# EasyEDA Pro project Foc驱动板.eprj, board PCB1_1 (continued)
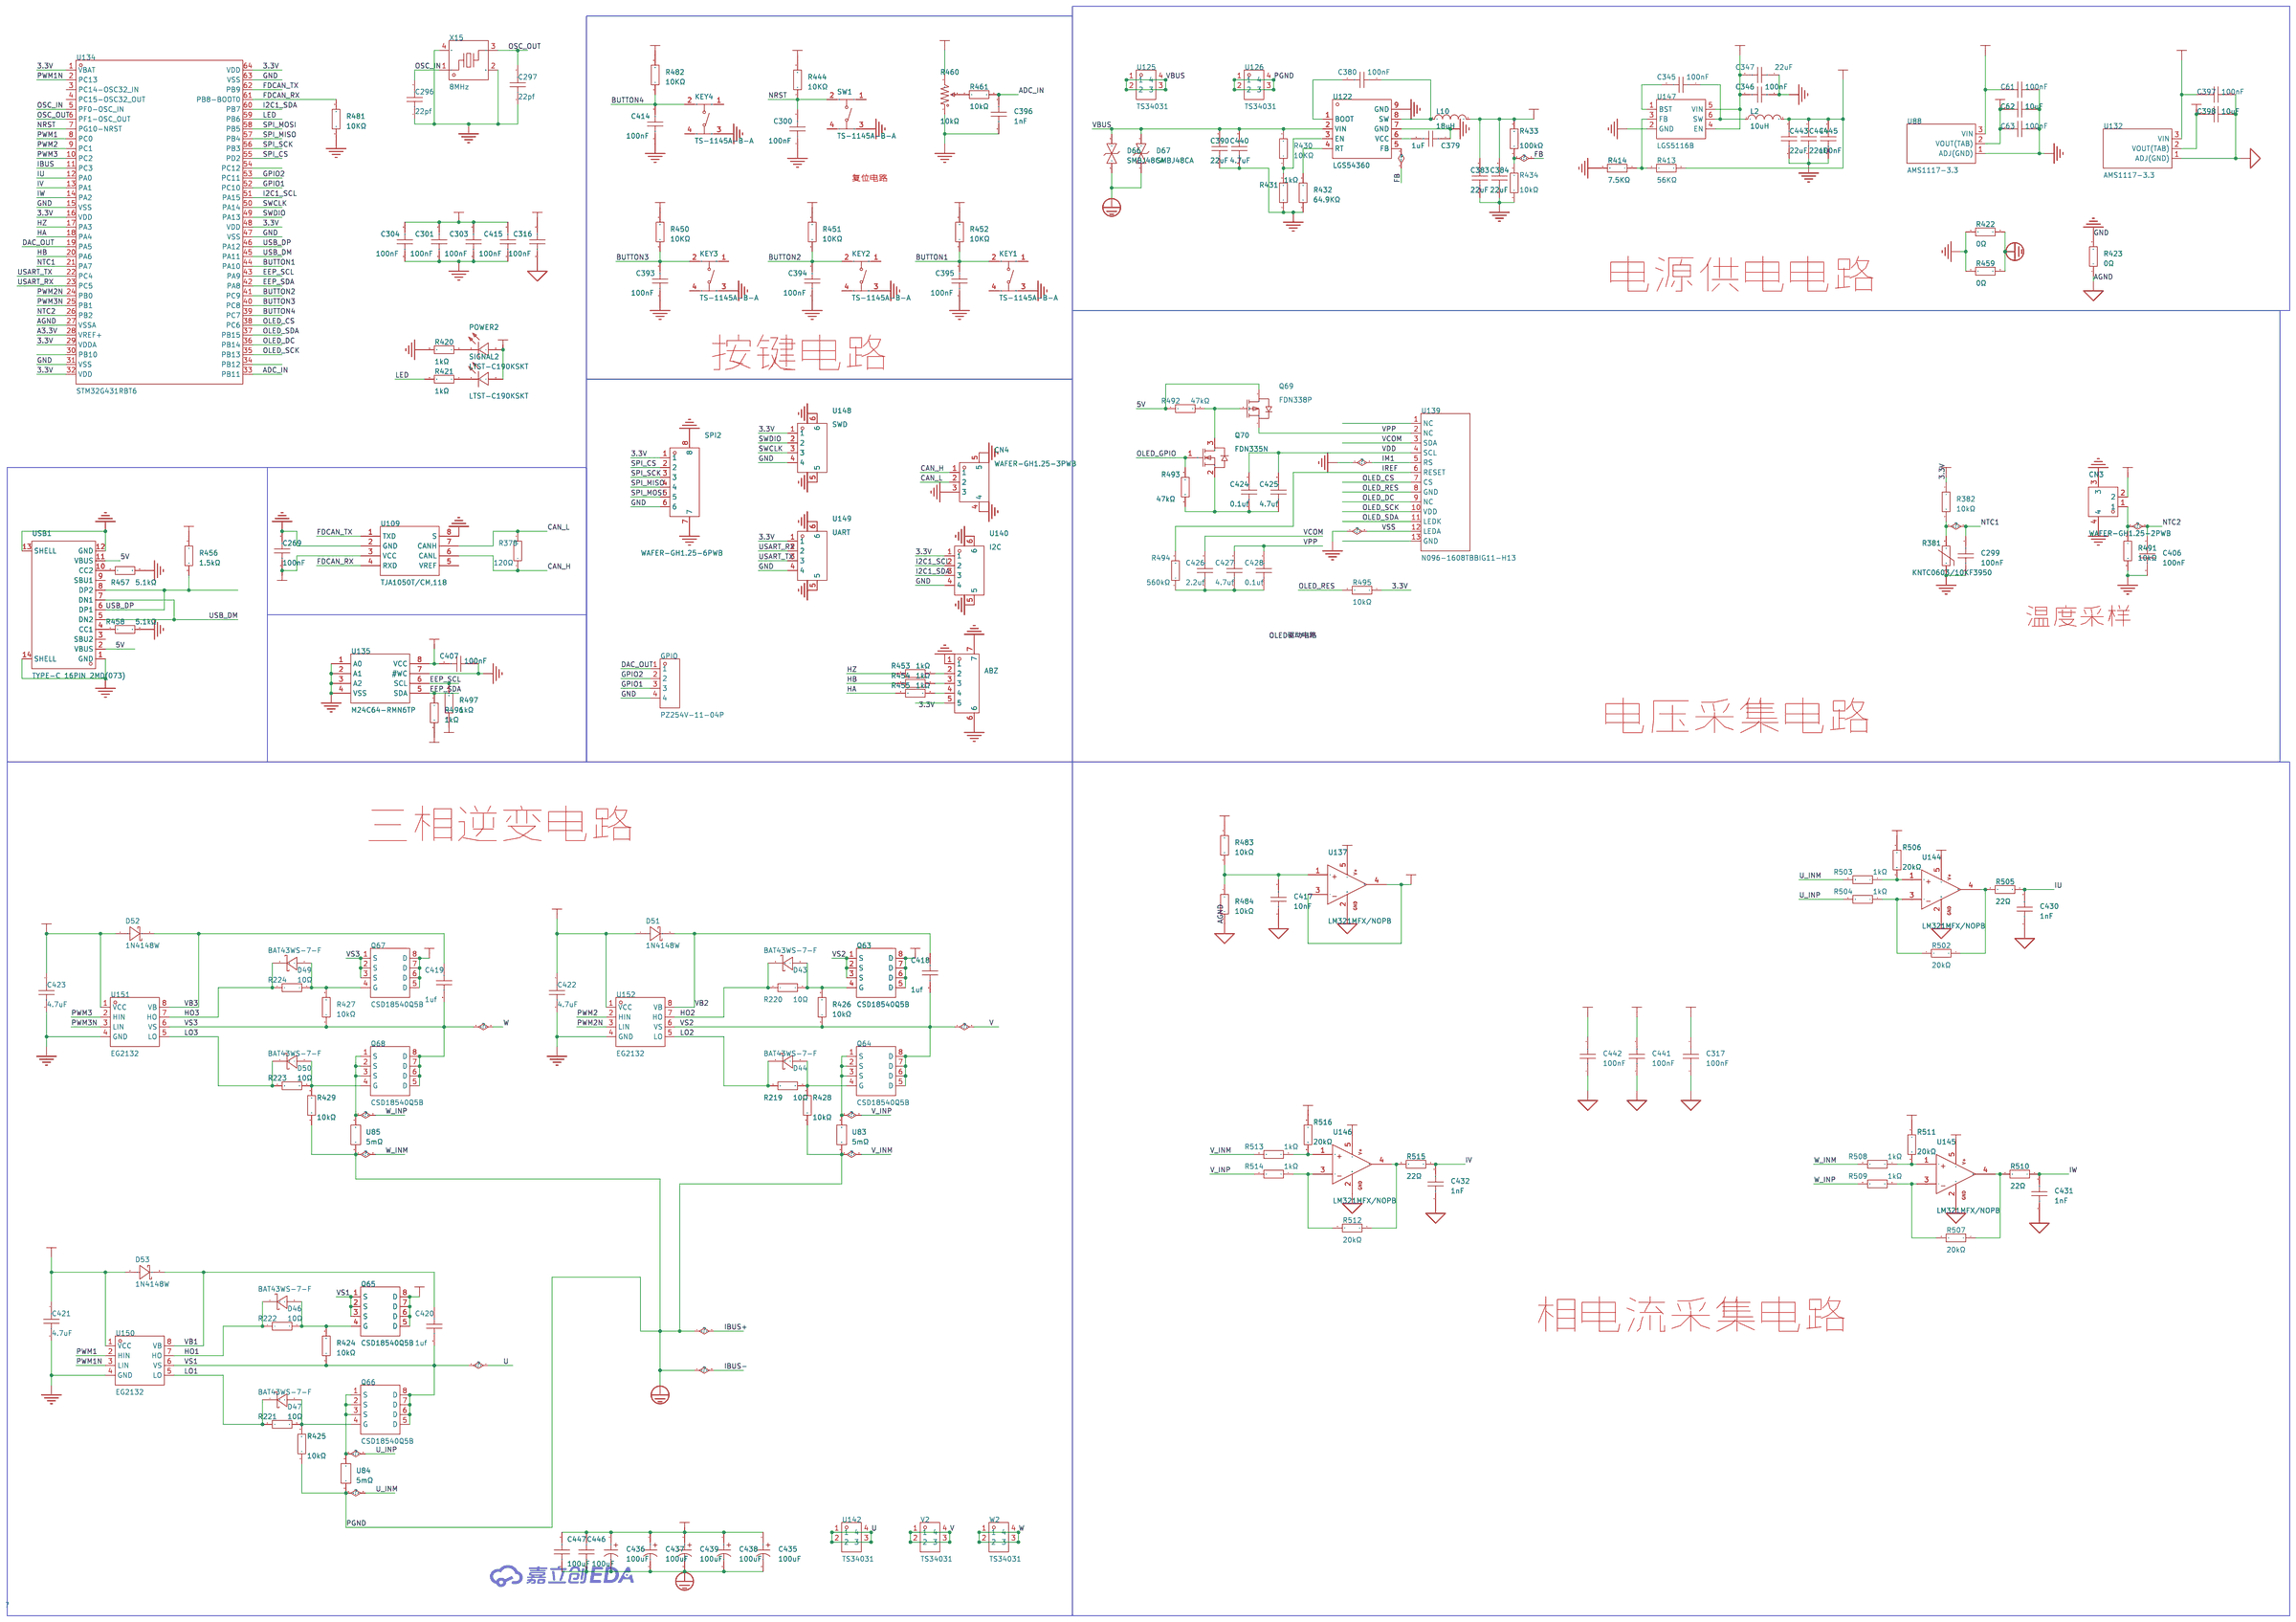
[diagram p0: schematic sheet]
## Nets (continued)
$1N9259: D43.2 Q63.4 R220.2 R426.2
$1N9267: D44.2 Q64.4 R219.2 R428.2
$1N9279: D50.2 Q68.4 R223.2 R429.2
$1N9280: D49.2 Q67.4 R224.2 R427.2
$1N9402: U134.54
$1N9439: U134.34
$1N9459: U134.30
$1N9505: C380.2 U122.1
$1N9518: 1.3 OLED.13
$1N9519: 1.3 OLED.1
$1N9527: NMOS.3 PMOS.1 R492.2
$1N9530: C424.1 C425.1 NMOS.2 R493.1
$1N9531: C426.1 C427.1 C428.1 R494.1
$1N9558: C417.2 R483.2 R484.1 U137.1
$1N10528: IU.3 R503.1 R506.2
$1N11288: IV.1 R512.1 R515.2
$1N24102: R413.2 R414.1 U147.3
$1N24243: C345.1 L2.1 U147.6
$1N30541: IV.3 R513.1 R516.2
$1N30545: IV.4 R512.2 R514.1
$1N30710: IW.3 R508.1 R511.2
$1N30717: IW.4 R507.2 R509.1
$1N30753: IW.1 R507.1 R510.2
$1N30817: IU.4 R502.2 R504.1
$1N30853: IU.1 R502.1 R505.2

Pads without a net: CANIC 5; KEY1 1 4; KEY2 1 4; KEY3 1 4; KEY4 1 4; RESET> 1 4; U134 3 4; USB 3 9

## Via types
v1: diameter 0.61, hole 0.305, Top Layer to Bottom Layer, 1010 vias
v2: diameter 0.508, hole 0.305, Top Layer to Bottom Layer, 92 vias

## Routing (per net, layer and track width the routed paths; a pad name or vN(x,y) marks a point on that pad's centre or on a via; arc(x,y) is an arc through that point)
3.3V: length 398.8
  Top Layer w0.254: v1(28.83,61.91) C301.2 27.94,64.13 28.25,64.45 U134.64 32.2,64.45 32.57,64.08 U134.1 ; 41.72,90.98 41.78,91.04 41.78,91.82 41.53,92.08 38.99,92.08 38.35,91.44 R496.2 R497.2 35.25,87.56 C407.2 34.48,87.24 EEPROM.8 ; 41.72,90.98 42.54,90.98 ; 41.72,90.98 41.68,90.93 41.15,90.93 40.64,90.42 40.64,84.07 40.98,83.74 POWER.2 ; 63.88,83.25 v1(63.88,84.21) ; 5.38,67.79 4.19,67.79 ; R495.1 v1(28.96,96.13) ; I2C.1 6.37,35.28 v1(6.4,35.31) ; U134.16 v1(40.64,62.45) ; U134.48 32.57,75 32,75.56 28,75.56 C304.2 27.94,74.8 ; C303.2 41.02,60.45 v1(40.64,60.07) ; 5.19,82.12 5.11,82.04 v1(3.94,82.04) ; SPI.1 v1(6.4,26.49) ; R456.1 v1(3.94,53.47) ; R452.2 v1(63.95,92.05) ; 5.38,76.8 5.29,76.71 v1(4.19,76.71) ; R482.2 63.93,68.4 v1(63.88,68.45) ; U134.29 40.68,70.45 40.39,70.74 40.39,71.63 40.71,71.95 U134.32 43.37,71.95 43.69,72.26 C415.2 44.51,74.48 v1(44.58,74.42) ; v1(46.99,69.41) 46.99,68.07 46.48,67.56 46.48,65.41 45.97,64.9 44.83,64.9 44.58,64.64 v1(44.58,62.23) ; R382.1 v1(49.66,34.16) ; v1(62.99,75.44) 63.79,75.44 R450.2
  Top Layer w0.381: v1(41.72,84.57) 41.72,83.77 POWER.2 ; R444.2 v1(58.17,83.95) v1(47.77,83.95)
  Top Layer w0.508: ABZ.5 v1(3.68,9.95)
  Inner2 w0.254: v1(63.88,68.45) 63.88,70.23 62.99,71.12 v1(62.99,75.44) 62.99,83.95 63.25,84.21 ; v1(49.66,34.16) v1(49.66,40.77) ; v1(40.64,60.07) 41.91,60.07 42.16,60.33 42.16,61.98 42.42,62.23 v1(44.58,62.23) ; 56.13,94.87 59.69,94.87 61.02,93.54 63.31,93.54 63.95,92.9 v1(63.95,92.05) 63.84,91.95 63.12,91.95 62.86,91.69 62.86,84.58 63.12,84.33 63.13,84.33 63.25,84.21 ; v1(27.94,74.8) 27.94,93.22 28.32,93.6 v1(28.96,93.6) ; 63.25,84.21 v1(63.88,84.21) ; 47.75,82.82 47.75,83.04 v1(47.77,83.06) ; v1(46.99,71.5) 43.56,71.5 42.8,70.74 38.61,70.74 38.1,70.23 38.1,62.61 37.4,61.91 v1(28.83,61.91)
  Inner2 w0.381: v1(28.96,96.13) 47.24,96.13 47.88,96.77 55.37,96.77 55.75,96.39 55.75,95.25 56.13,94.87 55.75,94.49 55.75,93.73 56.26,93.22 57.66,93.22 58.17,92.71 v1(58.17,83.95)
  Inner2 w0.762: v1(47.75,94.49) 47.24,95 13.84,95 9.91,91.06 5.08,91.06 3.94,89.92 v1(3.94,82.04) 3.94,76.96 v1(4.19,76.71) v1(4.19,67.82) 4.19,53.85 4.57,53.47 ; 4.57,53.47 v1(3.94,53.47) ; 4.57,53.47 4.95,53.09 4.95,35.69 5.33,35.31 v1(6.4,35.31) v1(6.4,26.49) 6.35,26.54 4.06,26.54 3.68,26.16 v1(3.68,9.95)
  Bottom Layer w0.254: v1(41.72,84.57) 46.35,84.57 v1(46.97,83.95) ; v1(46.99,71.5) 45.09,71.5 44.58,72.01 v1(44.58,74.42) ; v1(28.96,96.13) v1(28.96,93.6) ; v1(44.58,62.23) 49.28,62.23 49.53,61.98 49.53,56.13 51.44,54.23 51.44,50.16 50.93,49.66 50.93,47.24 52.07,46.1 52.07,42.39 51.59,41.91 49.91,41.91 49.66,41.66 v1(49.66,40.77) ; v1(40.64,60.07) v1(40.64,62.45)
  vias: v1(42.54,90.97) v1(46.97,83.06) v1(46.99,81.15) v1(46.99,80.14) v1(46.99,70.47) v1(47.78,81.15) v1(47.78,80.14) v1(47.88,71.5) v1(47.88,70.46) v1(47.88,69.37)
5V: length 107.1
  Top Layer w0.254: v1(20.32,58.61) C269.1 19.24,58.67 CANIC.3
  Top Layer w0.508: USB.11 v1(8.38,41.54) ; v1(8.38,46.35) 8.37,46.34 USB.2
  Inner2 w0.762: v1(29.59,82.68) 29.59,83.19 29.84,83.44 35.43,83.44 36.7,82.17 52.58,82.17 53.45,81.3 v1(53.45,77.47) ; v1(30.48,82.68) 30.61,82.55 33.27,82.55 34.04,81.79 34.04,79.76 35.18,78.61 35.18,69.98 34.67,69.47 21.21,69.47 20.7,68.96 20.7,58.99 v1(20.32,58.61) 15.17,58.61 13.97,59.82 9.4,59.82 8.89,59.31 8.89,46.99 8.38,46.48 v1(8.38,46.35) 9,45.74 9,42.16 v1(8.38,41.54)
  vias: v1(50.17,66.3) v1(51.02,67.18) v1(51.02,66.3) v1(51.82,66.29) v1(53.45,76.47) v1(54.48,77.47) v1(54.5,76.47)
12V: length 7.6
  Top Layer w0.254: 61.09,58.67 66.8,58.67 67.56,57.91 R433.2
  vias: v1(23.56,44.78) v1(23.56,43.88) v1(24.45,44.78) v1(24.45,43.87) v1(36,45.03) v1(36,44.14) v1(36.89,45.03) v1(36.89,44.12) v1(48.7,45.16) v1(48.7,44.27) v1(49.59,45.16) v1(49.59,44.25) v1(50.48,45.16) v1(50.48,44.27) v1(51.37,45.16) v1(51.37,44.25) v1(52.96,59.05) v1(52.96,58.16) v1(53.85,59.05) v1(53.85,58.15) v1(54.74,59.05) v1(54.74,58.11) v1(55.63,59.05) v1(55.63,58.11) v1(56.51,59.05) v1(56.51,58.12)
A3.3V: length 68
  Top Layer w0.254: U137.5 48.23,57.91 47.75,57.91 47.5,58.17 47.5,59.88 47.06,60.33 C398.1 ; U137.5 48.29,57.31 v1(48.26,57.28) ; U137.5 48.29,58.52 v1(48.26,58.55) ; v1(41.28,58.55) 41.95,58.55 R483.1 ; v1(34.8,51.18) 34.83,51.21 IV.5 34.83,53.31 C441.2 ; v1(44.07,70.1) 43.91,69.95 U134.28 ; 21.14,53.47 21.14,52.16 IU.5 21.08,52.1 v1(21.08,51.31) ; v1(48.01,54.36) 47.62,54.36 47.43,54.16 C442.2 47.43,52.04 IW.5 47.4,51.21 v1(47.37,51.18)
  Inner2 w0.254: v1(47.37,51.18) v1(34.8,51.18) 21.21,51.18 v1(21.08,51.31) ; v1(41.28,58.55) v1(48.26,58.55)
  Bottom Layer w0.254: v1(48.26,57.28) 48.01,57.02 v1(48.01,54.36) ; v1(44.07,70.1) 41.78,70.1 41.28,69.6 v1(41.28,58.55)
AGND: length 95.9
  Top Layer w0.254: v1(48.77,52.35) 48.83,52.41 C442.1 48.83,54.29 49.4,54.86 49.4,58.8 49.78,59.18 50.29,59.18 50.67,59.56 50.67,60.26 C398.2 ; 46.23,52.32 46.1,52.2 46.1,51.31 45.85,51.05 IW.2 43.75,51.05 43.18,50.48 ; v1(33.53,52.37) 33.53,51.44 33.15,51.05 IV.2 30.8,51.05 V_OUT.1 ; C398.2 v1(51.31,60.33) ; C398.2 50.61,61.6 U132.1 52.6,62.25 52.96,62.61 R423.1 52.96,67.44 52.32,68.07 49.15,68.07 48.83,67.75 48.83,67.18 v1(48.01,67.18) ; v1(44.97,60.2) 45.47,60.2 46.74,58.93 46.74,57.28 46.48,57.02 U137.2 v1(44.83,57.02) ; v1(44.96,69.85) 44.56,69.45 U134.27 ; v1(19.81,52.38) 19.81,51.44 19.56,51.18 17.21,51.18 U_OUT.1 ; 22.54,53.47 22.61,53.41 22.61,52.58 22.67,52.51 v1(22.67,52.32) ; v1(41.28,57.02) 41.99,57.02 R484.2 42.1,56.91 C417.1 ; v1(36.19,52.35) 36.26,52.41 C441.1
  Inner2 w0.254: v1(19.81,52.38) 22.61,52.38 v1(22.67,52.32) 36.17,52.32 v1(36.19,52.35) v1(46.16,52.35) v1(48.77,52.35) ; v1(44.83,57.02) v1(41.28,57.02) ; v1(44.97,60.2) 51.18,60.2 v1(51.31,60.33)
  Bottom Layer w0.254: v1(48.01,67.18) 45.59,67.18 44.96,67.82 v1(44.96,69.85)
GND: length 107
  Top Layer w0.254: U134.15 39.57,63.58 39.75,63.75 43.18,63.75 43.43,63.5 v1(43.43,63.12) ; C423.2 46.54,42.99 v1(46.48,42.93) ; v1(33.07,76.45) v1(33.07,75.66) U134.47 ; v1(37.08,81.03) 37.08,79.33 EEPROM.3 ; v1(26.3,60.51) v1(25.4,60.51) ; v1(26.3,60.51) C301.1 ; v1(26.3,60.51) 26.3,64.15 27.1,64.95 U134.63 ; R481.1 21.54,57.21 C269.2 19.11,57.4 CANIC.2 ; v1(14.15,79.12) v1(14.15,78.08) 1.3 OLED.12 ; X15.2 37.06,56.81 C297.1 38.04,56.96 v1(38.61,56.39) ; EEPROM.7 35.75,84.26 34.48,82.99 EEPROM.1 ; EEPROM.2 35.69,79.32 v1(35.69,80.77) ; 1.3 OLED.5 19.05,73.28 v1(19.05,79.12) 19.05,80.12 v1(19.06,80.13) ; C303.1 44.2,60.45 v1(44.2,60.45) ; v1(7.58,56.39) 9.91,56.39 10.16,56.13 CANIC.8 ; v1(44.83,77.47) 44.83,76.2 44.51,75.88 C415.1 ; v1(44.58,70.87) 43.99,71.45 U134.31 ; v1(48.89,29.84) 49.03,29.84 R381.1 C299.1 ; v1(38.3,81.03) 38.3,79.28 EEPROM.4 41.07,79.26 R420.2 ; v1(67.06,49.15) 67.06,49.16 R432.1 ; X15.4 30.63,58.51 C296.1 29.91,57.78 v1(29.34,57.78)
  Inner2 w0.254: v1(48.89,29.84) 48.89,41.78 48.51,42.16 46.74,42.16 46.48,42.42 v1(46.48,42.93)
  Bottom Layer w0.254: 44.2,60.45 43.69,60.45 43.43,60.71 v1(43.43,63.12) ; v1(38.61,59.05) v1(38.61,57.66) v1(38.61,56.39) 38.61,55.88 38.23,55.5 v1(37.34,55.5) v1(35.94,55.5) v1(34.54,55.5) v1(33.15,55.5) v1(31.75,55.5) v1(30.35,55.5) 30.1,55.5 v1(29.34,56.26) v1(29.34,57.78) v1(29.34,59.05)
  vias: v1(0.81,24.26) v1(0.8,23.37) v1(0.8,22.48) v1(0.8,13.34) v1(0.79,12.45) v1(0.79,11.56) v1(1.09,83.62) v1(1.08,82.74) v1(1.08,81.85) v1(1.17,33.4) v1(1.17,32.51) v1(1.21,66.8) v1(1.2,65.91) v1(1.2,65.02) v1(1.18,34.29) v1(1.27,3.68) v1(1.32,75.82) v1(1.31,74.93) v1(1.31,74.04) v1(1.34,59.04) v1(1.33,58.15) v1(1.33,57.26) v1(1.4,96.27) v1(1.4,53.59) v1(1.7,24.26) v1(1.69,23.37) v1(1.69,22.48) v1(1.68,13.34) v1(1.68,12.45) v1(1.68,11.56) v1(1.78,5.08) v1(1.91,97.66) v1(1.97,82.74) v1(1.97,81.85) v1(1.91,2.16) v1(2.03,94.74) v1(1.98,83.62) v1(2.07,34.29) v1(2.06,33.4) v1(2.06,32.51) v1(2.1,66.8) v1(2.09,65.91) v1(2.09,65.02) v1(2.21,75.82) v1(2.2,74.93) v1(2.2,74.04) v1(2.23,59.04) v1(2.22,58.15) v1(2.22,57.26) v1(2.27,44.32) v1(2.27,43.43) v1(2.3,53.59) v1(2.6,24.26) v1(2.6,23.37) v1(2.6,22.48) v1(2.59,13.34) v1(2.58,12.45) v1(2.58,11.56) v1(2.88,83.62) v1(2.88,82.74) v1(2.88,81.85) v1(2.97,33.4) v1(2.97,32.51) v1(3,66.8) v1(3,65.91) v1(3,65.02) v1(2.98,34.29) v1(3.11,75.82) v1(3.11,74.93) v1(3.11,74.04) v1(3.13,59.04) v1(3.13,58.15) v1(3.13,57.26) v1(3.16,44.32) v1(3.16,43.43) v1(3.43,5.84) v1(3.43,1.53) v1(3.56,98.42) v1(3.56,94.11) v1(4.97,2.16) v1(5.01,5.08) v1(5.13,97.66) v1(5.1,94.74) v1(5.62,3.68) v1(5.75,96.27) v1(6.97,62.61) v1(6.97,61.72) v1(6.98,63.5) v1(7.11,52.51) v1(7.37,19.81) v1(7.36,18.92) v1(7.36,18.03) v1(7.87,63.5) v1(7.86,62.61) v1(7.86,61.72) v1(8,8.37) v1(7.99,7.48) v1(7.99,6.59) v1(8,5.72) v1(7.99,4.83) v1(7.99,3.94) v1(8,3.05) v1(7.99,2.16) v1(7.99,1.27) v1(8.25,19.81) v1(8.25,18.92) v1(8.25,18.03) v1(8.89,8.37) v1(8.88,7.48) v1(8.88,6.59) v1(8.89,5.72) v1(8.88,4.83) v1(8.88,3.94) v1(8.89,3.05) v1(8.88,2.16) v1(8.88,1.27) v1(9.16,19.81) v1(9.15,18.92) v1(9.15,18.03) v1(9.79,8.37) v1(9.78,7.48) v1(9.78,6.59) v1(9.79,5.72) v1(9.78,4.83) v1(9.78,3.94) v1(9.79,3.05) v1(9.78,2.16) v1(9.78,1.27) v1(13.71,87.38) v1(13.7,86.49) v1(13.7,85.6) v1(14.06,42.59) v1(14.05,41.7) v1(14.05,40.81) v1(14.6,87.38) v1(14.59,86.49) v1(14.59,85.6) v1(14.95,42.59) v1(14.94,41.7) v1(14.94,40.81) v1(15.51,87.38) v1(15.5,86.49) v1(15.5,85.6) v1(19.43,55.37) v1(20.71,55.37) v1(21.2,87.5) v1(21.2,86.61) v1(21.2,85.72) v1(21.95,55.37) v1(22.09,87.5) v1(22.09,86.61) v1(22.09,85.72) v1(22.61,57.78) v1(22.61,56.77) v1(23,87.5) v1(22.99,86.61) v1(22.99,85.72) v1(23.2,55.36) v1(23.46,57.78) v1(23.51,56.77) v1(25.21,76.39) v1(25.21,75.5) v1(25.21,74.49) v1(25.21,73.6) v1(26.1,76.39) v1(26.1,75.5) v1(26.1,74.49) v1(26.1,73.6) v1(26.8,25.65) v1(28.35,42.4) v1(28.35,41.51) v1(29.24,42.4) v1(29.24,41.51) v1(29.4,63.56) v1(29.4,62.67) v1(29.78,74.49) v1(29.78,73.6) v1(30.29,63.56) v1(30.29,62.67) v1(30.67,74.49) v1(30.67,73.6) v1(33.46,89.34) v1(33.46,88.46) v1(33.53,68.58) v1(34.36,90.28) v1(34.64,68.58) v1(35.25,90.28) v1(36.32,70.38) v1(36.32,68.58) v1(37.34,70.36) v1(39.27,68.58) v1(39.37,70.1) v1(41.64,42.42) v1(41.64,41.53) v1(42.1,73.22) v1(42.53,42.42) v1(42.53,41.53) v1(42.99,73.22) v1(51.43,71.63) v1(51.42,70.74) v1(51.44,69.85) v1(51.44,68.98) v1(52.32,71.63) v1(52.31,70.74) v1(52.96,61.09) v1(52.96,60.2) v1(53.85,60.2) v1(54.35,86.74) v1(54.34,85.85) v1(54.34,84.96) v1(54.35,82.93) v1(54.34,82.04) v1(54.34,81.15) v1(54.36,80.26) v1(55.24,86.74) v1(55.23,85.85) v1(55.23,84.96) v1(56.15,86.74) v1(56.14,85.85) v1(56.14,84.96) v1(57.73,63.04) v1(57.73,61.94) v1(57.73,60.81) v1(58.04,56.13) v1(58.04,55.43) v1(58.93,50.04) v1(59.44,50.8) v1(59.69,76.07) v1(59.68,75.18) v1(59.68,74.3) v1(59.81,86.74) v1(59.81,85.85) v1(59.81,84.96) v1(60.03,50.04) v1(60.57,76.07) v1(60.57,75.18) v1(60.57,74.3) v1(60.7,86.74) v1(60.69,85.85) v1(60.69,84.96) v1(60.68,50.8) v1(61.28,50.04) v1(61.47,76.07) v1(61.46,75.18) v1(61.46,74.3) v1(61.61,86.74) v1(61.6,85.85) v1(61.6,84.96) v1(62.36,55.24) v1(62.43,54.41) v1(62.44,53.47) v1(63.37,53.47) v1(63.4,55.24) v1(63.4,54.41) v1(63.93,62.13) v1(64.01,96.14) v1(64.45,55.24) v1(64.45,54.38) v1(64.45,53.47) v1(64.52,97.54) v1(64.64,94.61) v1(65.51,84.78) v1(65.51,77) v1(65.53,69.21) v1(66.17,98.3) v1(66.17,93.98) v1(66.29,46.74) v1(66.32,45.85) v1(66.63,85.87) v1(66.62,84.78) v1(66.63,83.63) v1(66.63,78.09) v1(66.62,77) v1(66.63,75.85) v1(66.66,70.31) v1(66.65,69.21) v1(66.66,68.06) v1(66.8,52.32) v1(67.75,97.54) v1(67.71,94.61) v1(67.81,84.78) v1(67.81,77) v1(67.83,69.21) v1(68.36,96.14) v2(11.94,14.8) v2(11.94,13.91) v2(11.94,12.89) v2(12.7,18.73) v2(12.7,17.84) v2(12.7,16.83) v2(12.7,14.8) v2(12.7,13.91) v2(12.7,12.89) v2(12.83,46.74) v2(12.83,45.72) v2(12.83,44.7) v2(12.83,43.69) v2(12.83,42.67) v2(12.83,41.66) v2(12.83,40.64) v2(12.83,39.75) v2(12.83,38.73) v2(12.83,35.5) v2(12.83,34.61) v2(12.83,33.59) v2(12.83,26.1) v2(12.83,25.08) v2(26.29,18.61) v2(26.29,17.72) v2(26.29,16.7) v2(26.54,45.97) v2(26.54,43.05) v2(26.54,42.16) v2(26.54,41.15) v2(26.54,40.22) v2(26.54,39.24) v2(26.54,38.35) v2(34.42,66.42) v2(36.32,66.45) v2(37.97,42.93) v2(37.97,42.04) v2(37.97,41.02) v2(37.97,40) v2(37.97,38.99) v2(37.97,37.97) v2(39.24,66.42) v2(39.37,37.72) v2(39.5,42.55) v2(39.5,41.53) v2(39.5,40.51) v2(39.5,39.5) v2(39.5,38.48) v2(39.5,26.61) v2(39.5,25.59) v2(39.5,18.73) v2(39.5,17.84) v2(39.5,16.83)
PGND: length 187.4
  Top Layer w0.203: v2(19.75,47.27) 19.71,47.32 R503.2 ; 45.47,12.17 45.47,14.99 45.21,15.24 41.66,15.24 v1(41.4,14.99) ; v1(28.45,14.86) 28.78,15.19 32.18,15.19 32.38,14.99 U83.1 ; v2(46.19,47.15) 46.15,47.19 R508.2 ; R513.2 33.72,47.32 ; v1(14.86,15.24) 15.11,15.49 18.67,15.49 18.92,15.24 18.92,12.43
  Top Layer w0.381: 15.11,10.16 13.72,10.16 13.34,10.53 R425.1 ; R429.1 40.17,20.29 40.17,10.13 ; R428.1 27.18,19.82 27.18,10.42
  Inner2 w0.203: 38.56,15.88 38.56,47.45 arc(38.7,47.79) 39.04,47.93 45.92,47.93 arc(46.11,47.85) 46.19,47.66 v2(46.19,47.15) ; 38.56,15.88 38.56,15.75 ; 38.56,15.88 arc(38.72,15.48) 39.12,15.32 41.07,15.32 v1(41.4,14.99) ; v1(14.86,15.24) 14.53,15.57 12.32,15.57 arc(12.01,15.7) 11.89,16 11.89,47.5 arc(12.11,48.04) 12.65,48.26 19.3,48.26 arc(19.57,48.15) 19.69,47.88 19.69,47.34 v2(19.75,47.27) ; v2(33.62,47.27) 33.62,47.66 arc(33.54,47.85) 33.35,47.93 26.67,47.93 26.66,47.94 25.95,47.94 25.48,47.47 25.48,15.66 arc(25.61,15.33) 25.95,15.19 28.12,15.19 v1(28.45,14.86)
  vias: v1(22.81,11.3) v1(23.62,11.3) v1(24.38,11.3) v1(36.19,11.18) v1(37.04,11.18) v1(38.02,11.18) v1(52.57,31.38) v1(52.51,21.98) v1(52.51,21.09) v1(52.51,20.2) v1(52.52,19.17) v1(52.52,18.28) v1(52.52,17.4) v1(52.57,12.19) v1(52.58,30.49) v1(52.58,29.6) v1(52.58,28.57) v1(52.58,27.68) v1(52.58,26.79) v1(52.58,11.3) v1(52.58,10.41) v1(52.58,9.38) v1(52.58,8.49) v1(52.58,7.6) v1(53.02,45.29) v1(53.02,44.39) v1(53.09,47.06) v1(53.09,46.17) v1(53.47,31.37) v1(53.47,30.48) v1(53.47,29.59) v1(53.47,28.56) v1(53.41,21.97) v1(53.41,21.09) v1(53.41,20.2) v1(53.41,19.17) v1(53.41,18.28) v1(53.41,17.39) v1(53.47,12.18) v1(53.47,11.29) v1(53.47,10.4) v1(53.47,9.37) v1(53.48,27.67) v1(53.48,26.78) v1(53.48,8.48) v1(53.48,7.59) v1(53.85,47.06) v1(53.85,46.15) v1(53.78,45.29) v1(53.78,44.38) v1(54.36,31.37) v1(54.36,30.48) v1(54.36,29.59) v1(54.36,28.56) v1(54.36,27.67) v1(54.36,26.78) v1(54.29,21.97) v1(54.3,21.09) v1(54.3,20.2) v1(54.3,19.17) v1(54.3,18.28) v1(54.3,17.39) v1(54.36,12.18) v1(54.36,11.29) v1(54.36,10.4) v1(54.36,9.37) v1(54.36,8.48) v1(54.36,7.59) v1(54.67,45.29) v1(54.67,44.39) v1(54.74,47.06) v1(54.74,46.17) v1(55.24,31.37) v1(55.24,30.48) v1(55.24,29.59) v1(55.25,28.56) v1(55.25,27.67) v1(55.25,26.78) v1(55.18,21.97) v1(55.18,21.09) v1(55.18,20.2) v1(55.18,19.17) v1(55.19,18.28) v1(55.19,17.39) v1(55.24,12.18) v1(55.24,11.29) v1(55.24,10.4) v1(55.25,9.37) v1(55.25,8.48) v1(55.25,7.59) v1(55.56,45.29) v1(55.56,44.38) v1(55.63,47.06) v1(55.63,46.15) v1(56.77,47.06) v1(56.77,46.17) v1(56.77,45.28) v1(57.53,47.04) v1(57.53,46.17) v1(57.53,45.27) v1(58.42,46.17) v1(58.42,45.28) v1(59.31,46.1) v1(59.31,45.27) v1(60.2,46.1) v1(60.2,45.21) v1(61.65,15.18) v1(61.6,14.16) v1(61.65,13.14) v1(62.39,22.36) v1(62.42,21.4) v1(62.42,20.51) v1(62.56,14.16) v1(62.6,15.18) v1(62.6,13.14) v1(63.28,22.36) v1(63.31,21.4) v1(63.31,20.51) v1(63.47,14.16) v1(63.51,15.18) v1(63.51,13.14) v1(64.01,3.56) v1(64.16,22.36) v1(64.2,21.4) v1(64.2,20.51) v1(64.44,15.18) v1(64.4,14.16) v1(64.44,13.14) v1(64.52,4.95) v1(64.64,2.03) v1(65.18,22.36) v1(65.21,21.4) v1(65.21,20.51) v1(65.46,19.59) v1(65.46,18.71) v1(65.46,17.81) v1(65.46,16.98) v1(65.46,16.06) v1(65.46,15.11) v1(65.46,14.16) v1(65.46,13.17) v1(65.46,12.21) v1(65.46,11.26) v1(65.46,10.43) v1(65.46,9.51) v1(65.46,8.6) v1(66.06,25.17) v1(66.04,24.38) v1(66.04,23.54) v1(66.07,22.36) v1(66.11,21.4) v1(66.11,20.51) v1(66.17,5.72) v1(66.17,1.4) v1(66.45,14.16) v1(66.49,15.18) v1(66.49,13.14) v1(66.96,22.36) v1(66.99,21.4) v1(66.99,20.51) v1(67.44,15.18) v1(67.4,14.16) v1(67.44,13.14) v1(67.75,4.95) v1(67.71,2.03) v1(67.84,22.36) v1(67.88,21.4) v1(67.88,20.51) v1(68.36,15.18) v1(68.32,14.16) v1(68.36,13.14) v1(68.36,3.56)
VBUS: length 7.7
  Top Layer w0.254: R430.2 68.57,48.89 v1(68.58,48.89)
  Bottom Layer w0.254: v1(62.75,50.18) 62.77,50.16 68.07,50.16 68.58,49.66 v1(68.58,48.89)
  vias: v1(54.54,40.12) v1(54.54,39.24) v1(54.54,38.35) v1(54.54,37.32) v1(54.55,36.43) v1(54.55,35.54) v1(55.43,40.12) v1(55.43,39.24) v1(55.43,38.35) v1(55.43,37.32) v1(55.43,36.43) v1(55.43,35.54) v1(56.31,40.12) v1(56.31,39.24) v1(56.31,38.35) v1(56.31,37.32) v1(56.32,36.43) v1(56.32,35.54) v1(57.32,40.13) v1(57.33,39.24) v1(57.33,38.35) v1(57.33,37.32) v1(57.33,36.43) v1(57.33,35.54) v1(58.22,40.12) v1(58.22,39.23) v1(58.22,38.34) v1(58.22,37.31) v1(58.23,36.42) v1(58.23,35.53) v1(59.15,43.14) v1(59.15,42.25) v1(59.14,41.35) v1(59.11,40.12) v1(59.11,39.23) v1(59.11,38.34) v1(59.11,37.31) v1(59.11,36.42) v1(59.11,35.53) v1(59.99,40.12) v1(59.99,39.23) v1(59.99,38.34) v1(60,37.31) v1(60,36.42) v1(60,35.53) v1(60.17,41.35) v1(60.18,44.02) v1(60.18,43.14) v1(60.18,42.25) v1(60.96,40.14) v1(60.96,39.25) v1(60.96,38.36) v1(60.96,37.33) v1(60.96,36.44) v1(61.07,44.02) v1(61.07,43.14) v1(61.07,42.25) v1(61.06,41.36) v1(61.46,34.61) v1(61.5,35.62) v1(61.5,33.59) v1(61.96,44.02) v1(61.96,43.14) v1(61.96,42.25) v1(61.95,41.36) v1(62.04,28.26) v1(62.04,27.37) v1(62.1,26.57) v1(62.45,35.62) v1(62.41,34.61) v1(62.45,33.59) v1(62.83,44.02) v1(62.83,43.13) v1(62.83,42.24) v1(62.82,41.35) v1(62.93,28.26) v1(62.93,27.37) v1(62.99,26.57) v1(63.37,35.62) v1(63.33,34.61) v1(63.37,33.59) v1(63.72,44.02) v1(63.72,43.14) v1(63.72,42.25) v1(63.71,41.35) v1(63.82,28.26) v1(63.82,27.37) v1(63.88,26.57) v1(64.25,34.61) v1(64.26,25.15) v1(64.26,24.38) v1(64.26,23.58) v1(64.3,35.62) v1(64.3,33.59) v1(64.61,44.02) v1(64.61,43.14) v1(64.61,42.25) v1(64.6,41.35) v1(64.83,28.26) v1(64.83,27.37) v1(64.89,26.57) v1(65.31,40.04) v1(65.31,39.15) v1(65.31,38.25) v1(65.31,37.43) v1(65.31,36.51) v1(65.31,35.56) v1(65.31,34.61) v1(65.31,33.61) v1(65.31,32.65) v1(65.31,31.71) v1(65.31,30.87) v1(65.31,29.96) v1(65.31,29.05) v1(65.64,44.02) v1(65.64,43.14) v1(65.64,42.25) v1(65.63,41.35) v1(65.72,28.25) v1(65.72,27.36) v1(65.78,26.57) v1(66.34,35.62) v1(66.3,34.61) v1(66.34,33.59) v1(66.53,44.02) v1(66.53,43.14) v1(66.53,42.25) v1(66.52,41.36) v1(66.61,28.25) v1(66.61,27.36) v1(66.67,26.57) v1(67.25,34.61) v1(67.3,35.62) v1(67.3,33.59) v1(67.42,44.02) v1(67.42,43.14) v1(67.42,42.25) v1(67.41,41.36) v1(67.5,28.25) v1(67.5,27.36) v1(67.56,26.57) v1(68.17,34.61) v1(68.21,35.62) v1(68.21,33.59)
VDD: length 29.3
  Top Layer w0.254: C425.2 30,92.58 20.45,92.58 19.75,91.89 1.3 OLED.4
ADC_IN: length 30.2
  Top Layer w0.127: U134.33 40.07,77.16 40.51,77.6 43.05,77.6 43.18,77.72 43.18,91.57 44.05,92.43 v1(49.53,92.43) ; C396.2 v1(49.53,92.43) ; v1(49.53,92.43) R461.2
BUTTON1: length 49.9
  Top Layer w0.127: v1(33.15,78.36) 33.15,78.23 34.57,76.81 U134.44
  Top Layer w0.254: KEY1.2 65.66,90.97 65.66,90.04 65.29,89.67 R452.1 v1(63.95,88.74) C395.2
  Bottom Layer w0.127: v1(33.15,78.36) 50.55,78.36 51.82,79.63 62.86,79.63 63.12,79.88 63.12,88.52 63.25,88.65 64.01,88.65
BUTTON2: length 38.6
  Top Layer w0.127: U134.41 v2(36.07,76.58)
  Top Layer w0.254: 63.88,79.95 v1(63.88,80.91) R451.1 65.11,81.74 65.6,82.24 KEY2.2
  Bottom Layer w0.127: 63.88,80.77 63.88,79.76 63.37,79.25 51.94,79.25 51.31,78.61 51.31,76.83 51.05,76.58 37.8,76.58 37.76,76.54 37.33,76.54 37.29,76.58 v2(36.07,76.58)
BUTTON3: length 41.7
  Top Layer w0.127: U134.40 36.6,73.98 v2(36.6,76.05)
  Top Layer w0.254: C393.2 63.8,72.22 R450.1 65.05,73.94 65.6,74.49 KEY3.2
  Bottom Layer w0.127: v1(63.75,73.02) 63.75,78.1 62.99,78.87 52.07,78.87 51.56,78.36 51.56,76.45 51.16,76.05 v2(36.6,76.05)
BUTTON4: length 46.3
  Top Layer w0.127: U134.39 37.08,73.95 v2(37.08,75.56)
  Top Layer w0.254: R482.1 65.36,66.12 65.66,66.42 65.66,67.57 KEY4.2
  Bottom Layer w0.127: v2(37.08,75.56) 51.18,75.56 51.82,76.2 51.82,78.1 52.32,78.61 61.47,78.61 62.23,77.85 62.23,66.04 62.99,65.28 63.88,65.28
  vias: v1(63.93,65.28)
CAN_H: length 5.9
  Top Layer w0.254: 5.37,58.92 120.1 8.88,58.67 CANIC.6
CAN_L: length 5.9
  Top Layer w0.254: 5.38,57.67 8.38,57.67 120.2 8.64,57.4 CANIC.7
DAC_OUT: length 46.8
  Top Layer w0.127: v1(46.35,91.44) 46.35,82.8 45.97,82.42 45.97,65.91 45.51,65.45 U134.19
  Bottom Layer w0.127: v1(46.35,91.44) 46.35,95.38 45.72,96.01 35.05,96.01 34.67,96.39 预留GPIO:1->4
1:DAC 2:PC10
3:PC11 4:GND.1
EEP_SCL: length 15.3
  Top Layer w0.127: R497.1 37.02,87.2 EEPROM.6 37.08,84.61 37.08,83.31 36.7,82.93 35.43,82.93 35.07,82.57 U134.43
EEP_SDA: length 15.5
  Top Layer w0.127: U134.42 35.57,77.61 35.81,77.85 36.07,77.85 36.32,78.1 36.32,81.66 36.83,82.17 37.85,82.17 38.35,82.68 38.35,84.61 EEPROM.5 38.29,87.45 R496.1
FB: length 5.3
  Top Layer w0.254: U122.5 66.12,57.32 66.55,56.9 66.55,56.01 66.92,55.63 R433.1 R434.2
FDCAN_RX: length 21.9
  Top Layer w0.127: CANIC.4 21.21,59.94 arc(21.48,59.83) 21.59,59.56 R481.2 arc(21.59,58.67) 21.6,58.67 23.24,58.67 arc(23.6,58.82) 23.75,59.18 23.75,65.28 arc(23.95,65.75) 24.42,65.95 U134.61
FDCAN_TX: length 23.2
  Top Layer w0.127: U134.62 24.43,65.45 arc(24.22,65.36) 24.13,65.15 24.13,56.52 arc(23.98,56.16) 23.62,56.01 16.67,56.01 arc(16.59,56.04) CANIC.1
GPIO1: length 76.6
  Top Layer w0.254: v1(11.52,72.39) 11.51,72.4 11.51,98.63 11.81,98.93 38.86,98.93 39.5,98.3 39.5,97.66 预留GPIO:1->4
1:DAC 2:PC10
3:PC11 4:GND.3 ; v2(11.52,70.45) U134.52
  Inner1 w0.254: v2(11.52,70.45) v1(11.52,72.39)
GPIO2: length 75.5
  Top Layer w0.254: U134.53 28.04,69.95 27.78,69.69 v2(12.32,69.69) ; 预留GPIO:1->4
1:DAC 2:PC10
3:PC11 4:GND.2 37.21,95.88 36.83,95.5 33.15,95.5 32.77,95.88 32.77,97.79 32.26,98.3 12.83,98.3 12.35,97.82 v1(12.35,72.9)
  Inner1 w0.254: v2(12.32,69.69) 12.35,69.73 v1(12.35,72.9)
HA: length 84.9
  Top Layer w0.127: v1(13.97,65.02) 13.46,64.52 13.46,54.1 11.3,51.94 11.3,11.18 10.92,10.79 9.64,10.79 ; U134.18 42,65.02 v1(32.64,65.02)
  Bottom Layer w0.127: v1(32.64,65.02) v1(13.97,65.02)
HB: length 84.1
  Top Layer w0.127: 13.59,65.79 12.99,65.18 12.99,54.26 10.92,52.2 10.92,12.83 10.54,12.45 9.64,12.45 ; v1(33.53,65.91) 42.04,65.91 U134.20
  Bottom Layer w0.127: v1(33.53,65.91) v1(13.72,65.91) 13.59,65.79
HO1: length 14.3
  Top Layer w0.381: U150.7 v1(18.54,37.85) ; v1(13.97,31.88) 13.02,31.88 D46.1 13.34,31.5 R222.1
  Inner2 w0.381: v1(13.97,31.88) 13.97,37.46 14.35,37.85 v1(18.54,37.85)
HO2: length 13.3
  Top Layer w0.381: R220.1 26.81,31.36 D43.1 26.51,31.75 v1(27.23,31.75) ; U152.7 v1(30.73,37.97)
  Inner2 w0.381: v1(27.23,31.75) 27.56,31.75 27.94,32.13 27.94,37.72 28.19,37.97 v1(30.73,37.97)
HO3: length 13.3
  Top Layer w0.381: v1(40.51,31.88) D49.1 40.01,31.46 R224.1 ; U151.7 v1(44.07,37.93)
  Inner2 w0.381: v1(40.51,31.88) 40.89,32.26 40.89,37.46 41.36,37.93 v1(44.07,37.93)
HZ: length 81.7
  Top Layer w0.127: v1(12.32,64.26) 12.57,64.01 12.57,54.48 10.54,52.45 10.54,14.35 10.34,14.15 9.64,14.15 ; U134.17 v1(33.53,64.45)
  Bottom Layer w0.127: v1(12.32,64.26) 12.51,64.45 v1(33.53,64.45)
I2C1_SCL: length 62.6
  Top Layer w0.127: U134.51 9.1,70.95 8.89,70.74 ; I2C.2 v1(8.13,34.03)
  Bottom Layer w0.127: v1(8.13,34.03) 8.88,34.03 9.27,34.42 9.27,47.24 8.76,47.75 v1(8.76,70.61)
I2C1_SDA: length 59.4
  Top Layer w0.127: v1(9.4,66.42) 9.43,66.45 U134.60 ; I2C.3 v1(8.13,32.78)
  Bottom Layer w0.127: v1(8.13,32.78) 9.03,32.78 9.65,33.4 9.65,47.5 9.14,48.01 9.14,66.17 v1(9.4,66.42)
IREF: length 36.3
  Top Layer w0.254: 1.3 OLED.6 18.35,93.66 v1(18.41,93.73) ; v1(18.41,96.77) 18.8,97.16 29.97,97.16 30.19,96.94 R494.2
  Bottom Layer w0.254: v1(18.41,93.73) v1(18.41,96.77)
IU: length 34
  Top Layer w0.127: U134.12 38.07,60.2 arc(38.19,59.92) 38.47,59.8 39,59.8 arc(39.35,59.66) 39.5,59.31 39.5,55.24 arc(39.38,54.96) 39.09,54.84 17.12,54.84 arc(16.78,54.7) 16.65,54.36 16.65,53.47
  Top Layer w0.254: U_OUT.2 16.64,53.46 16.65,53.47
IV: length 20.8
  Top Layer w0.127: U134.13 38.57,60.87 arc(38.69,60.57) 38.99,60.45 39.37,60.45 arc(39.91,60.23) 40.13,59.69 40.13,55.12 arc(39.87,54.49) 39.24,54.23 30.61,54.23 arc(30.43,54.16) 30.36,53.98 R515.1
  Top Layer w0.254: V_OUT.2 30.35,53.2
IW: length 22.2
  Top Layer w0.127: v1(47.12,61.21) 39.2,61.21 arc(39.11,61.25) 39.07,61.34 U134.14 ; R510.1 42.93,53.35 42.93,53.97 arc(43,54.15) 43.18,54.23 46.48,54.23 arc(46.75,54.34) 46.86,54.61 46.86,55.12
  Top Layer w0.254: R510.1 42.93,53.33 W_OUT.2
  Bottom Layer w0.127: v1(47.12,55.12) v1(47.12,61.21)
LED: length 32.4
  Top Layer w0.254: U134.59 32.15,66.95 32.38,67.18 32.38,69.09 32.77,69.47 v1(36.58,69.47) ; v1(43.81,85.6) 43.81,77.47 43.49,77.14 41.84,77.14 41.4,76.71 v1(41.4,74.55) ; R421.2 v1(42.54,85.61)
  Bottom Layer w0.254: v1(41.4,74.55) 41.4,70.74 40.13,69.47 v1(36.58,69.47) ; v1(43.81,85.6) 43.8,85.61 v1(42.54,85.61)
LO1: length 21.5
  Top Layer w0.381: R221.1 13.34,23.58 D47.1 12.19,24 11.81,24.38 11.81,35.94 12.19,36.32 15.49,36.32 16,36.83 U150.5
LO2: length 21.5
  Top Layer w0.254: U152.5 v1(28.19,40.51)
  Top Layer w0.381: R219.1 26.68,23.46 D44.1 26.26,24.43 v1(26.47,24.64)
  Bottom Layer w0.381: v1(28.19,40.51) 28.19,25.02 27.81,24.64 v1(26.47,24.64)
LO3: length 21.2
  Top Layer w0.381: U151.5 v1(41.53,40.39) ; v1(39.62,24.76) 39.62,23.91 D50.1 40.01,23.46 R223.1
  Bottom Layer w0.381: v1(41.53,40.39) 41.53,25.27 41.02,24.76 v1(39.62,24.76)
NRST: length 44.9
  Top Layer w0.127: v2(57.15,77.98) 57.15,80.39 57.53,80.77 58.17,80.77 58.18,80.76 ; 58.18,80.76 C300.2 ; 58.18,80.76 58.18,81.66 R444.1 ; U134.7 v2(35.57,63.88)
  Top Layer w0.254: R444.1 59.57,81.67 59.96,82.06 RESET>.2
  Bottom Layer w0.127: v2(57.15,77.98) 56.9,78.23 52.45,78.23 52.2,77.98 52.2,75.69 51.56,75.06 41.63,75.06 41.62,75.07 41.19,75.07 41.17,75.06 40.64,75.06 40.51,74.93 40.51,71.37 40.26,71.12 35.94,71.12 35.57,70.75 v2(35.57,63.88)
NTC1: length 52.7
  Top Layer w0.127: U134.21 v1(44.83,66.45)
  Top Layer w0.254: C299.2 49.72,26.42 50.29,26.42 50.42,26.54 v1(50.42,32) 50.41,32.01 R382.2
  Top Layer w0.508: R382.2 R381.2
  Inner2 w0.127: v1(50.42,32) 50.16,32.26 50.16,33.94 50.18,33.95 50.18,34.38 50.16,34.39 50.16,40.07 50.35,40.26 50.37,40.26 50.46,40.35 v1(50.46,40.76)
  Bottom Layer w0.127: v1(50.46,40.76) 50.46,41.32 50.67,41.53 52.07,41.53 52.36,41.82 52.36,46.22 52.2,46.39 52.2,46.74 51.73,47.21 51.73,54.57 49.82,56.48 49.82,62.1 49.66,62.26 49.66,62.36 49.02,62.99 45.72,62.99 44.58,64.13 44.58,66.19 v1(44.83,66.45)
NTC2: length 66.8
  Top Layer w0.127: C406.2 3.17,89.89 R491.1 4.67,87.78 4.95,87.5 4.95,83.52 4.81,83.37 6.03,83.37 v1(6.1,83.31) ; v1(45.59,83.44) 45.59,69.47 45.07,68.95 U134.26
  Bottom Layer w0.127: v1(45.59,83.44) 45.47,83.31 v1(6.1,83.31)
OLED_CS: length 26.7
  Top Layer w0.127: U134.38 37.55,73.97 v1(37.55,77.06) ; 1.3 OLED.7 v2(17.65,74.8)
  Bottom Layer w0.127: v2(17.65,74.8) 17.65,76.91 17.8,77.06 v1(37.55,77.06)
OLED_DC: length 28.5
  Top Layer w0.127: 1.3 OLED.9 16.26,73.28 v2(16.26,75.31) ; U134.36 v2(38.57,72.52)
  Bottom Layer w0.127: v2(38.57,72.52) 16.38,72.52 16.26,72.64 v2(16.26,75.31)
OLED_GPIO: length 1.8
  Top Layer w0.254: NMOS.1 31.23,88.87 R493.2
OLED_RES: length 31.9
  Top Layer w0.254: 1.3 OLED.8 16.95,93.79 17.91,94.74 27.82,94.74 R495.2
OLED_SCK: length 29.8
  Top Layer w0.127: U134.35 v2(39.07,71.88) ; v2(15.49,74.8) 15.55,74.74 1.3 OLED.10
  Bottom Layer w0.127: v2(15.49,74.8) 15.49,72.39 16,71.88 v2(39.07,71.88)
OLED_SDA: length 31.2
  Top Layer w0.127: U134.37 38.09,73.97 v1(38.09,77.72) ; v2(14.86,75.31) 14.86,73.28 1.3 OLED.11
  Bottom Layer w0.127: v1(38.09,77.72) 15.24,77.72 14.86,77.34 v2(14.86,75.31)
OSC_IN: length 8.9
  Top Layer w0.152: X15.1 33.06,56.81 34.04,57.78 34.04,59.56 34.54,60.07 34.54,62.42 U134.5
  Top Layer w0.203: X15.1 32.66,56.96 C296.2
OSC_OUT: length 6.2
  Top Layer w0.152: U134.6 35.07,58.57 X15.3
  Top Layer w0.203: X15.3 37.06,58.51 C297.2
PWM1: length 35.5
  Top Layer w0.127: v2(18.5,45.72) 18.54,45.68 U150.2 ; U134.8 v2(36.07,61.13)
  Bottom Layer w0.127: v2(18.5,45.72) 18.5,60.79 18.83,61.13 v2(36.07,61.13)
PWM1N: length 33.3
  Top Layer w0.127: v1(24.89,59.69) 32.64,59.69 33.07,60.12 ; v1(23.5,46.23) 17.4,46.23 17.27,46.1 U150.3
  Top Layer w0.254: U134.2 33.07,60.12
  Bottom Layer w0.127: v1(24.89,59.69) 24.89,46.74 24.38,46.23 v1(23.5,46.23)
PWM2: length 30.8
  Top Layer w0.127: U152.2 v2(30.73,45.72) ; v2(36.59,60.45) 36.6,60.46 36.6,62.42 U134.9
  Bottom Layer w0.127: v2(30.73,45.72) 30.73,46.48 30.48,46.74 27.18,46.74 27.05,46.86 27.05,60.33 27.18,60.45 v2(36.59,60.45)
PWM2N: length 38.7
  Top Layer w0.127: v2(39.12,50.55) 38.35,50.55 37.85,50.04 37.85,46.99 37.34,46.48 29.84,46.48 29.46,46.1 U152.3 ; U134.24 v2(40.26,67.95)
  Bottom Layer w0.127: v2(39.12,50.55) 39.12,56.16 39.13,56.17 39.13,59.27 39.12,59.28 39.12,60.07 38.99,60.2 37.34,60.2 37.08,60.45 37.08,67.44 37.6,67.95 v2(40.26,67.95)
PWM3: length 24.3
  Top Layer w0.127: v2(37.58,60.96) 37.21,60.96 37.07,61.1 U134.10 ; U151.2 v2(44.07,45.85)
  Bottom Layer w0.127: v2(44.07,45.85) 40.39,45.85 40.12,46.11 40.12,60.34 39.5,60.96 v2(37.58,60.96)
PWM3N: length 25.5
  Top Layer w0.127: v2(42.8,46.35) U151.3 ; 42.07,68.45 v2(43.35,68.45)
  Bottom Layer w0.127: v2(42.8,46.35) 42.8,68.2 43.05,68.45 v2(43.35,68.45)
